# EasyEDA Pro project Arduino UNO DIY.eprj, schematic Schematic5
Board Name: ESP12F Shield; Create Date: 2025-09-25; Page Name: P1; Project Name: Arduino UNO DIY; Schematic Name: Schematic5; Update Date: 2025-09-26; Company: m039; Drawn: Dmitry Mozgin; Page Size: A4; Version: V1.0
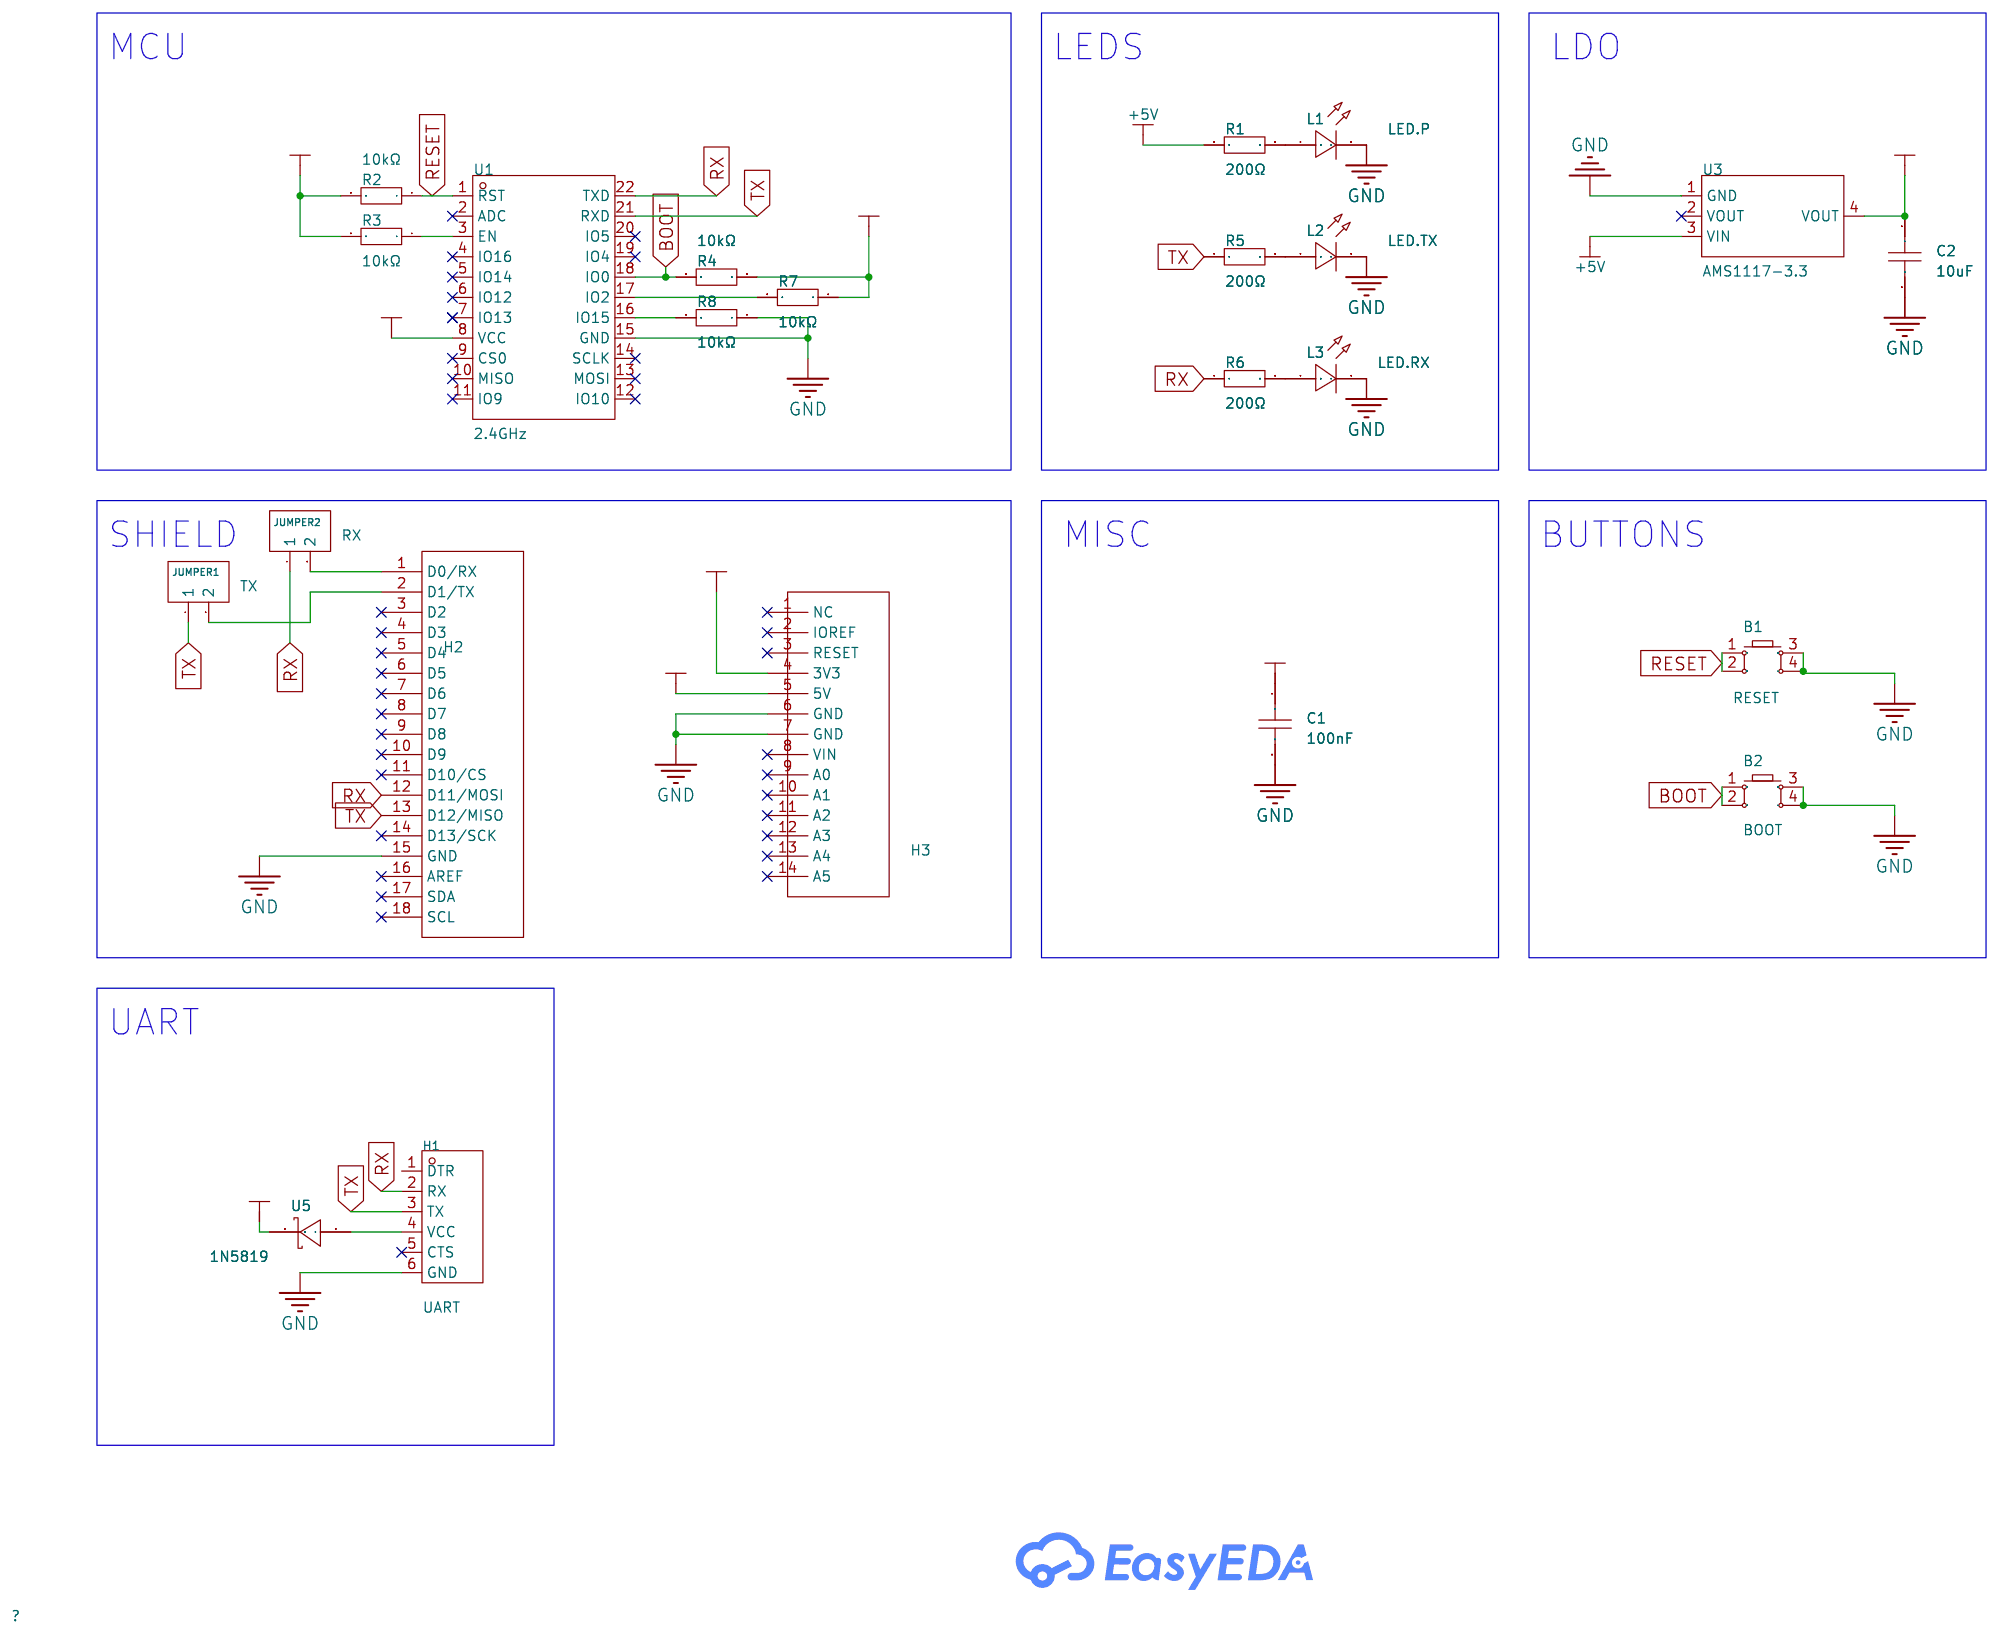
[diagram p5: schematic sheet]

## Parts
B1  RESET  [KEY-TH_4P-L6.0-W6.0-P3.90-LS6.5]
B2  BOOT  [KEY-TH_4P-L6.0-W6.0-P3.90-LS6.5]
C1  100nF  [CAP-TH_L4.8-W2.4-P5.08-D0.6]
C2  10uF  [CAP-TH_L4.8-W2.4-P5.08-D0.6]
H1  UART  [HDR-TH_6P-P2.54-V-F]
H2  -  [Arduino Uno Top Header]
H3  -  [Arduino Uno Bottom Header]
JUMPER1  TX  [HDR-TH_2P-P2.54-V-F]
JUMPER2  RX  [HDR-TH_2P-P2.54-V-F]
L1  LED.P  [LED-TH_BD3.0-P2.54-FD]
L2  LED.TX  [LED-TH_BD3.0-P2.54-FD]
L3  LED.RX  [LED-TH_BD3.0-P2.54-FD]
R1  200Ω  [RES-TH_BD1.8-L3.2-P7.20-D0.4]
R2  10kΩ  [RES-TH_BD1.8-L3.2-P7.20-D0.4]
R3  10kΩ  [RES-TH_BD1.8-L3.2-P7.20-D0.4]
R4  10kΩ  [RES-TH_BD1.8-L3.2-P7.20-D0.4]
R5  200Ω  [RES-TH_BD1.8-L3.2-P7.20-D0.4]
R6  200Ω  [RES-TH_BD1.8-L3.2-P7.20-D0.4]
R7  10kΩ  [RES-TH_BD1.8-L3.2-P7.20-D0.4]
R8  10kΩ  [RES-TH_BD1.8-L3.2-P7.20-D0.4]
U1  2.4GHz  [WIRELM-SMD_ESP-12F]
U3  AMS1117-3.3  [SOT-223-3_L6.5-W3.4-P2.30-LS7.0-BR]
U5  1N5819  [SOD-123_L2.7-W1.7-LS3.8-RD]

## Library data of the parts
B1 B2 = Key_TH_6x6x4.5: Supplier Footprint: Through
C1 C2 = CC1H221KC1EDB44B1100: LCSC Part Name: 220pF ±10% 50V; Supplier Part: C2832511; Manufacturer: Dersonic(德尔创); Supplier Footprint: 插件,P=5.08mm; JLCPCB Part Class: Extended Part; Datasheet: https://atta.szlcsc.com/upload/public/pdf/source/20211103/ADF2DBCED823A6AEFAA1F6C91B9CD8F4.pdf; Supplier: LCSC; Tolerance: ±10%; Voltage Rating: 50V; Pin Spacing: 5.08mm; Temperature Coefficient: Y5P; Diameter: 4.8mm; Body Thickness: 2.4mm
H1 = HDR-F_2.54_1x6P: Supplier Footprint: Through; Supplier: LCSC; Manufacturer: BOOMELE(博穆精密); Manufacturer Part: 2.54-1*6P母; Supplier Part: C40877; JLCPCB Part Class: Extended Part
H2 = Arduino Uno Top Header
H3 = Arduino Uno Header Bottom
JUMPER1 JUMPER2 = HDR-F_2.54_1x2P: Supplier Footprint: Through
L1-L3 = LED_TH-R_3mm: Supplier Footprint: Through
R1-R8 = Res_AXIAL-1/8W: Supplier Footprint: Through
U1 = ESP-12F: LCSC Part Name: ESP8266 WiFi模组,32Mbit Flash, 通用模组; Supplier Part: C19949064; Manufacturer: DOIT(四博智联); Supplier Footprint: SMD,24x16mm; JLCPCB Part Class: Extended Part; Datasheet: https://atta.szlcsc.com/upload/public/pdf/source/20240112/4C731B83AC84B82D8ABE33233BB0FED4.pdf; Supplier: LCSC; Wireless Standard: WIFI4; Interface Type: IO；UART; Antenna Type: PCB; Output Power: 15dBm; Voltage - Supply: 3.3V; Receive  Current: 55mA; Send  Current: 375mA; Sensitivity: -96dBm; Operating Temperature: -40℃~+85℃
U3 = AMS1117-3.3_C6186: LCSC Part Name: 输出3.3V 1A; Supplier Part: C6186; Manufacturer: AMS; Supplier Footprint: SOT-223; JLCPCB Part Class: Basic Part; Datasheet: https://item.szlcsc.com/datasheet/AMS1117-3.3/6652.html; Supplier: LCSC; Output Type: Fixed; Voltage - Supply: 16V; Output Voltage: 3.3V; Output Current: 1A; Power Supply Rejection Ratio (PSRR): 72dB@(120Hz); Voltage Dropout: 1.1V@(800mA); standby current: 5mA; Features: Over Current Protection；Over Temperature Protection; Operating Temperature: -40℃~+125℃; Output Configuration: Positive; Number of Outputs: 1
U5 = 1N5819/SOD-123: Supplier: LCSC; Supplier Part: C9900010912; Manufacturer: null; JLCPCB Part Class: Extended Part

## Nets
+3.3V: C2.1 H3.4(3V3) R2.2 R3.2 R4.1 R7.1 U1.8(VCC) U3.4(VOUT)
+5V: C1.1 H3.5(5V) R1.1 U3.3(VIN) U5.1(C)
GND: B1.3 B1.4 B2.3 B2.4 C1.2 C2.2 H1.6(GND) H2.15(GND) H3.6(GND) H3.7(GND) L1.2(A) L2.2(A) L3.2(A) R8.1 U1.15(GND) U3.1(GND)
BOOT: B2.1 B2.2 R4.2 U1.18(IO0)
RESET: B1.1 B1.2 R2.1 U1.1(RST)
RX: H1.2(RX) H2.12(D11/MOSI) JUMPER2.1 R6.1 U1.22(TXD)
TX: H1.3(TX) H2.13(D12/MISO) JUMPER1.1 R5.1 U1.21(RXD)
$1N517: L1.1(C) R1.2
$1N2050: R3.1 U1.3(EN)
$1N2304: L2.1(C) R5.2
$1N2368: L3.1(C) R6.2
$1N2474: R7.2 U1.17(IO2)
$1N2521: R8.2 U1.16(IO15)
$1N3716: H1.4(VCC) U5.2(A)
$1N3877: H2.1(D0/RX) JUMPER2.2
$1N3882: H2.2(D1/TX) JUMPER1.2

Not connected (* = marked no-connect by the designer): H1 1(DTR) 5(CTS)*; H2 3(D2)* 4(D3)* 5(D4)* 6(D5)* 7(D6)* 8(D7)* 9(D8)* 10(D9)* 11(D10/CS)* 14(D13/SCK)* 16(AREF)* 17(SDA)* 18(SCL)*; H3 1(NC)* 2(IOREF)* 3(RESET)* 8(VIN)* 9(A0)* 10(A1)* 11(A2)* 12(A3)* 13(A4)* 14(A5)*; U1 2(ADC)* 4(IO16)* 5(IO14)* 6(IO12)* 7(IO13)* 9(CS0)* 10(MISO)* 11(IO9)* 12(IO10)* 13(MOSI)* 14(SCLK)* 19(IO4)* 20(IO5)*; U3 2(VOUT)*

## Notes on the sheet
- MCU
- LEDS
- LDO
- SHIELD
- MISC
- BUTTONS
- UART
